# EasyEDA Pro project MyWordEdit.eprj, board PCB1 (continued)
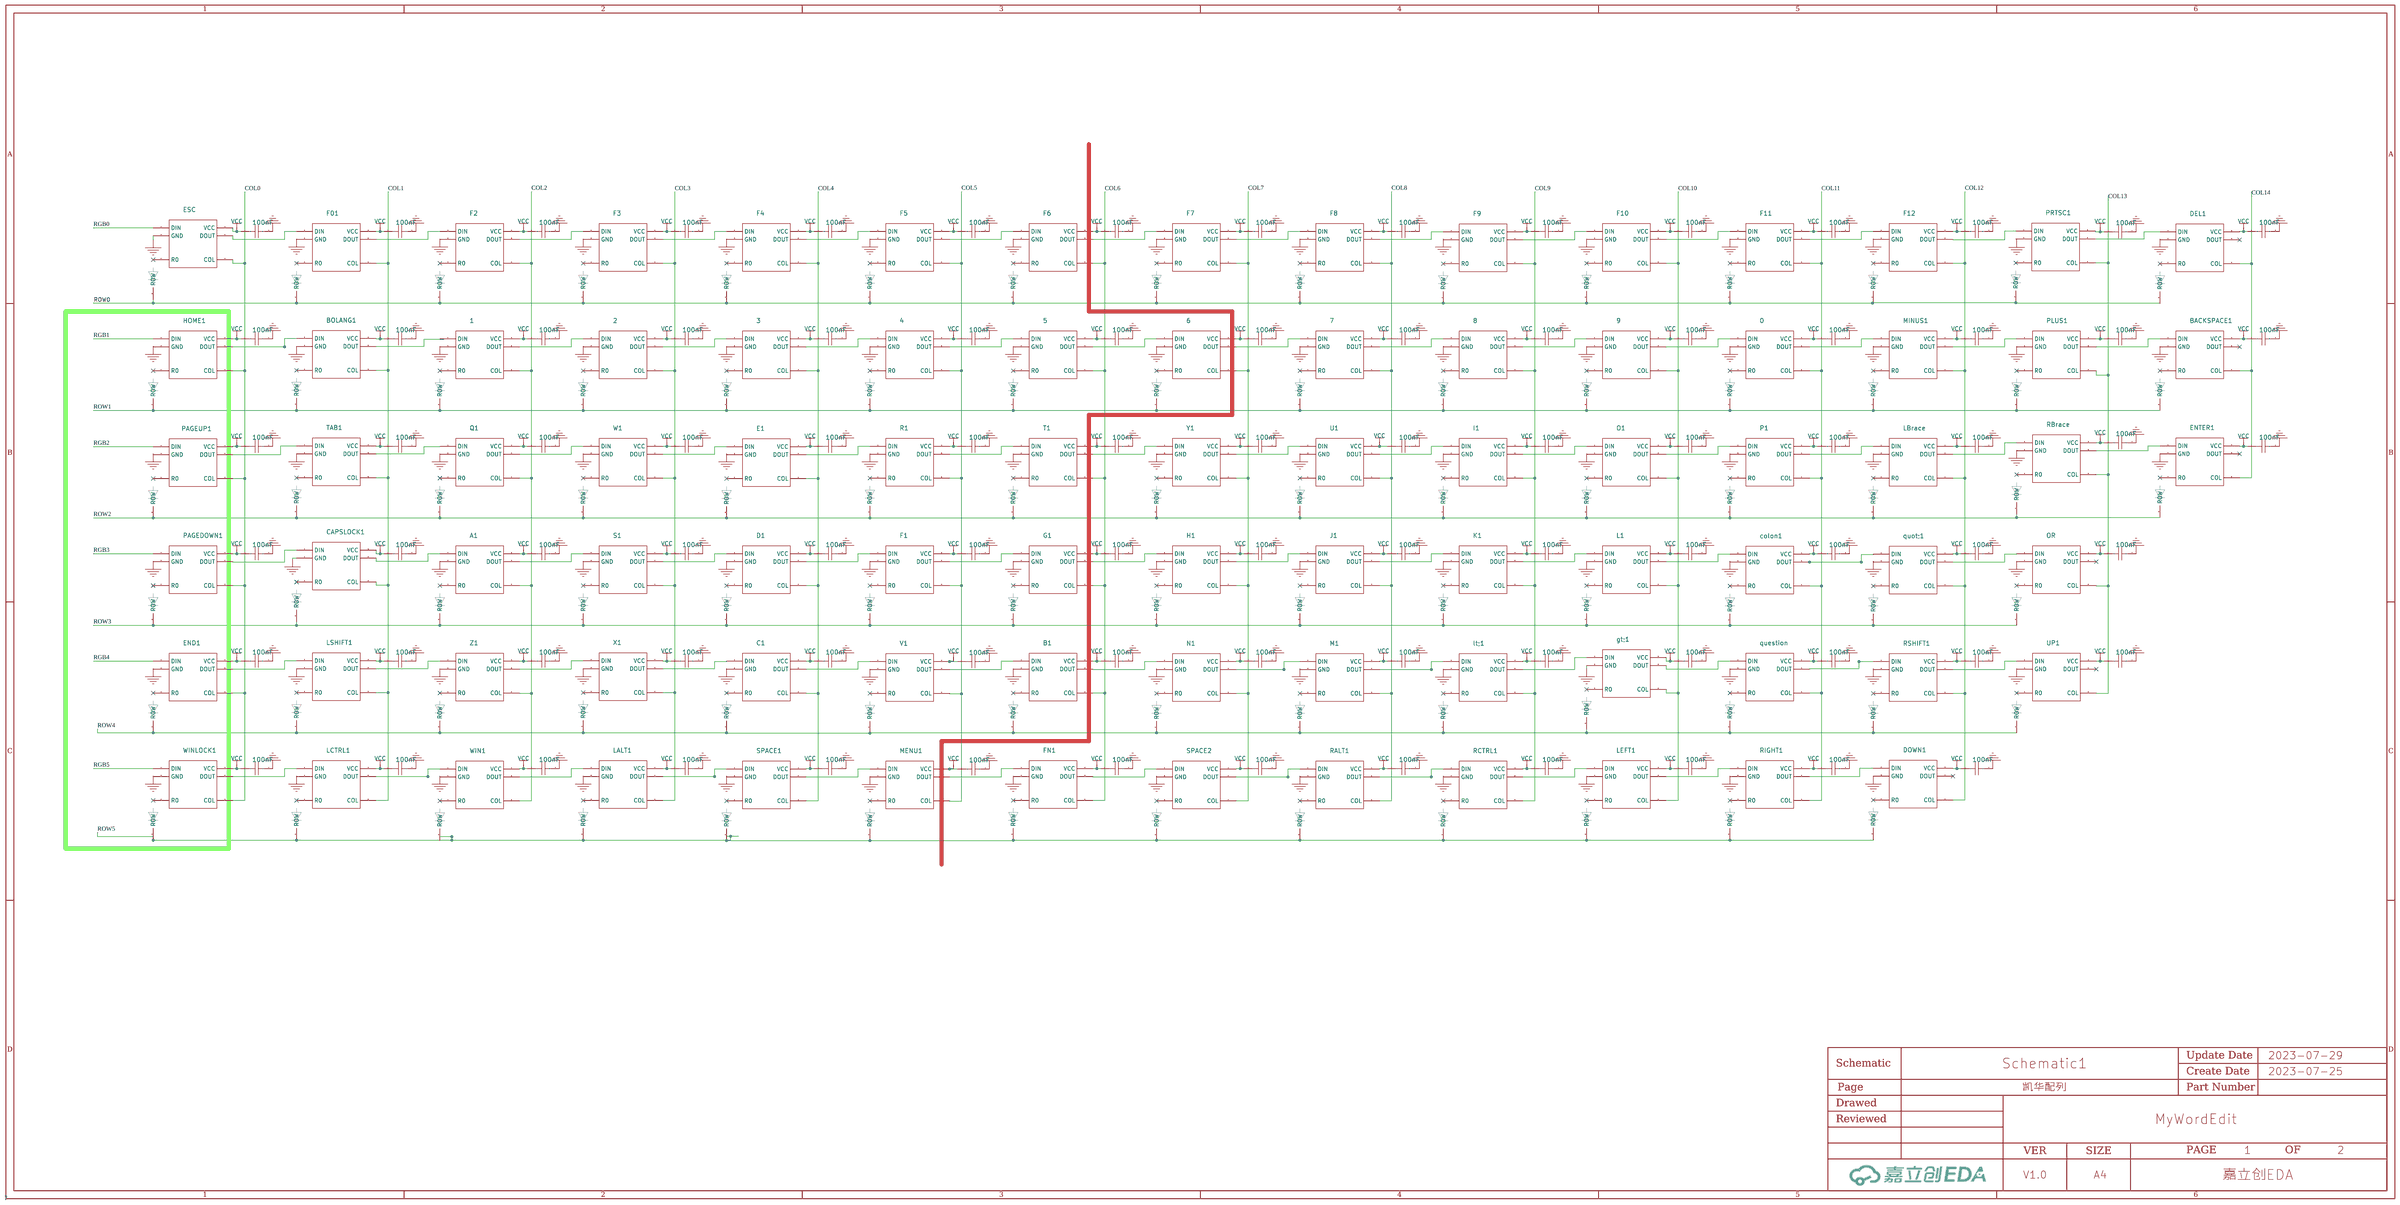
[diagram p0: 凯华配列]
## Routing (per net, layer and track width the routed paths; a pad name or vN(x,y) marks a point on that pad's centre or on a via; arc(x,y) is an arc through that point) (continued)
$2N29238: length 32
  Top Layer w0.254: v1(111.38,95) 112.14,94.23 116.46,94.23 117.6,93.09 129.41,93.09 129.79,92.71 137.29,92.71 138.05,93.47 138.05,94.49 v1(137.92,94.61)
  Bottom Layer w0.254: v1(137.92,94.61) 137.17,95.37 5.DIN ; v1(111.38,95) 111.42,95.03 4.DOUT
$2N29245: length 32.5
  Top Layer w0.254: v1(116.84,98.04) 111.51,103.38 109.22,103.38 108.08,104.52 98.17,104.52 95,101.35 93.85,101.35 92.84,100.33 92.84,98.42 v1(92.71,98.3)
  Bottom Layer w0.254: v1(92.71,98.3) 92.71,97.73 3.DOUT ; v1(116.84,98.04) 117.18,97.71 4.DIN
$2N29252: length 31.8
  Top Layer w0.254: v1(73.66,98.3) 74.3,97.66 89.92,97.66 91.57,96.01 99.38,96.01 100.08,96.7 v1(100.08,97.79)
  Bottom Layer w0.254: v1(73.66,98.3) 73.57,98.39 73.57,99.17 ; 3.DIN 99.2,98.67 v1(100.08,97.79)
$2N29259: length 32.5
  Top Layer w0.254: v1(79.12,101.22) 76.84,103.5 74.55,103.5 70.36,107.7 61.09,107.7 58.67,105.28 56.39,105.28 54.74,103.63 v1(54.74,101.73)
  Bottom Layer w0.254: 1.DOUT 54.74,101.16 v1(54.74,101.73) ; v1(79.12,101.22) 79.33,101.01 2.DIN
$2N29284: length 35.2
  Top Layer w0.254: v1(249.68,117.47) 251.84,119.63 251.84,120.4 256.54,125.09 275.08,125.09 275.84,124.33 v1(275.84,122.55)
  Bottom Layer w0.254: F12.DIN 275.84,121.78 v1(275.84,122.55) ; 251.72,117.72 251.48,117.47 v1(249.68,117.47)
$2N29291: length 36
  Top Layer w0.254: v1(259.21,119.25) 259.21,117.86 257.94,116.59 250.19,116.59 248.54,114.93 231.52,114.93 v1(230.63,115.82)
  Bottom Layer w0.254: v1(230.63,115.82) 230.88,116.07 F10.DOUT ; F11.DIN 258.6,119.86 v1(259.21,119.25)
$2N29298: length 34.7
  Top Layer w0.254: v1(238.25,119.25) 234.95,122.55 218.69,122.55 213.36,117.22 213.36,115.57 v1(212.09,114.3)
  Bottom Layer w0.254: F10.DIN 238.15,119.15 v1(238.25,119.25) ; F9.DOUT 212.21,114.42 v1(212.09,114.3)
$2N29305: length 36.1
  Top Layer w0.254: v1(221.23,116.46) 221.23,114.05 220.47,113.28 214.12,113.28 213.11,112.27 210.82,112.27 210.31,111.76 196.6,111.76 196.34,111.51 194.06,111.51 v1(192.91,112.65)
  Bottom Layer w0.254: v1(192.91,112.65) 193.03,112.77 F8.DOUT ; v1(221.23,116.46) 221.14,116.55 F9.DIN
$2N29312: length 34.8
  Top Layer w0.254: v1(200.03,116.08) 196.98,119.13 183.13,119.13 178.31,114.3 175.51,114.3 173.99,112.78 v1(173.99,111)
  Bottom Layer w0.254: F8.DIN 200.17,115.93 v1(200.03,116.08) ; v1(173.99,111) 174.11,111.12 F7.DOUT
$2N29319: length 43.7
  Top Layer w0.254: v1(148.97,111.76) 150.75,109.98 v1(158.5,109.98) ; v1(161.54,107.31) 168.72,107.31 169.91,108.51 176.2,108.51 177.8,110.11 181.99,110.11 183.01,111.12 v1(183.01,113.41)
  Bottom Layer w0.254: v1(161.54,107.31) 158.88,109.98 v1(158.5,109.98) ; F6.DOUT 150.89,111.76 v1(148.97,111.76) ; F7.DIN 182.85,113.25 v1(183.01,113.41)
$2N29326: length 31.6
  Top Layer w0.254: v1(156.85,113.79) 155.7,114.93 150.31,114.93 146.24,119 135.64,119 132.46,115.82 132.46,114.17 v1(132.33,114.05)
  Bottom Layer w0.254: F6.DIN 156.8,113.75 v1(156.85,113.79) ; v1(132.33,114.05) 132.33,113.48 F5.DOUT
$2N29333: length 35.9
  Top Layer w0.254: v1(111.51,115.06) 113.03,113.54 114.05,113.54 114.3,113.28 126.11,113.28 128.14,111.25 130.18,111.25 130.68,111.76 138.94,111.76 139.83,112.65 v1(139.83,114.3)
  Bottom Layer w0.254: v1(111.51,115.06) 113.05,115.06 113.2,114.91 ; F5.DIN 139.71,114.42 v1(139.83,114.3)
$2N29340: length 32
  Top Layer w0.254: v1(119,117.09) 115.57,120.52 110.87,120.52 109.09,122.3 97.28,122.3 94.62,119.63 94.62,117.73 v1(94.23,117.35)
  Bottom Layer w0.254: F4.DIN 119,116.11 v1(119,117.09) ; F3.DOUT 94.15,117.26 v1(94.23,117.35)
$2N29347: length 36
  Top Layer w0.254: v1(101.6,117.6) 101.22,117.22 101.22,115.32 100.84,114.93 95.38,114.93 95.12,115.19 94.74,115.19 94.11,114.55 89.54,114.55 87.38,116.71 75.06,116.71 v1(73.41,118.36)
  Bottom Layer w0.254: v1(101.6,117.6) 101.48,117.72 F3.DIN ; v1(73.41,118.36) 75.08,118.36 F2.DOUT
$2N29354: length 31.3
  Top Layer w0.254: v1(81.03,120.27) 79.05,122.25 72.28,122.25 70.3,120.27 66.04,120.27 63.12,123.19 57.28,123.19 56.26,122.17 v1(56.26,120.65)
  Bottom Layer w0.254: F2.DIN 80.98,120.23 v1(81.03,120.27) ; v1(56.26,120.65) 56.26,119.96 F01.DOUT
$2N36381: length 36.1
  Top Layer w0.254: v1(268.73,119.13) 269.49,118.36 282.58,118.36 283.46,119.25 288.04,119.25 288.54,119.76 288.54,119.89 296.29,119.89 297.43,121.03 v1(297.43,122.3)
  Bottom Layer w0.254: v1(268.73,119.13) 268.98,119.37 F12.DOUT ; v1(297.43,122.3) 296.58,123.16 PRTSC1.DIN
$2N36513: length 32.5
  Top Layer w0.254: v1(61.98,101.22) 61.98,99.82 61.6,99.44 53.34,99.44 50.93,101.85 46.74,101.85 45.85,100.96 36.45,100.96 v1(35.81,101.6)
  Bottom Layer w0.254: BOLANG1.DOUT 35.81,102.38 v1(35.81,101.6) ; 1.DIN 61.1,102.1 v1(61.98,101.22)
$2N38445: length 29.8
  Top Layer w0.254: v1(97.79,42.42) 97.28,42.93 89.79,42.93 88.9,42.04 87.88,42.04 84.84,45.08 74.8,45.08 73.79,44.07 v1(73.79,42.54)
  Bottom Layer w0.254: Z1.DOUT 73.79,42.36 v1(73.79,42.54) ; X1.DIN 98,42.21 v1(97.79,42.42)
$2N38463: length 29.2
  Top Layer w0.254: v1(135.51,39.37) 135.26,39.62 124.21,39.62 121.92,41.91 112.78,41.91 111.63,40.77 v1(111.63,39.37)
  Bottom Layer w0.254: v1(111.63,39.37) 111.63,38.93 C1.DOUT ; V1.DIN 135.97,38.9 v1(135.51,39.37)
$2N38472: length 34.1
  Top Layer w0.254: v1(130.56,35.94) 131.19,35.31 133.86,35.31 134.11,35.05 138.05,35.05 140.34,37.34 141.61,37.34 145.16,33.78 156.21,33.78 157.1,34.67 v1(157.1,35.31)
  Bottom Layer w0.254: B1.DIN 155.97,36.44 v1(157.1,35.31) ; v1(130.56,35.94) 130.56,36.59 V1.DOUT
$2N38479: length 48.1
  Top Layer w0.254: v1(159,37.59) 158.62,37.97 150.11,37.97 149.48,37.34 v1(149.48,35.94) ; v1(164.08,37.59) 164.26,37.77 166.83,37.77 v1(167.01,37.59) ; v1(191.01,38.99) 187.96,38.99 187.2,39.75 173.1,39.75 v1(171.07,37.72)
  Bottom Layer w0.254: v1(159,37.59) v1(164.08,37.59) ; v1(167.01,37.59) 167.25,37.84 170.95,37.84 v1(171.07,37.72) ; B1.DOUT 149.48,35.63 v1(149.48,35.94) ; v1(191.01,38.99) 191.9,38.99 192.68,38.21 N1.DIN
$2N38485: length 37.1
  Top Layer w0.254: v1(213.74,38.73) 213.74,37.08 212.85,36.19 200.28,36.19 199.14,37.34 197.74,37.34 194.95,34.54 186.06,34.54 185.29,35.31 v1(185.17,35.31)
  Bottom Layer w0.254: v1(213.74,38.73) 213.14,39.34 M1.DIN ; 187.21,35.55 185.41,35.55 v1(185.17,35.31)
$2N38500: length 29.8
  Top Layer w0.254: v1(230.25,42.04) 229.74,42.54 225.04,42.54 222.89,40.39 218.82,40.39 218.06,41.15 207.65,41.15 206.5,40 v1(206.5,37.97)
  Bottom Layer w0.254: v1(230.25,42.04) 230.65,41.63 lt;1.DIN ; v1(206.5,37.97) 206.5,37.57 M1.DOUT
$2N38515: length 34.9
  Top Layer w0.254: v1(251.08,41.91) 251.08,40 250.57,39.5 238.76,39.5 238.38,39.88 235.46,39.88 233.3,37.72 224.28,37.72 v1(223.39,38.61)
  Bottom Layer w0.254: gt;1.DIN 250.35,42.64 v1(251.08,41.91) ; lt;1.DOUT 224.94,38.61 v1(223.39,38.61)
$2N40060: length 36.3
  Top Layer w0.254: v1(320.04,49.91) 319.28,50.67 314.07,50.67 311.02,47.62 290.2,47.62 289.31,46.74 v1(289.31,45.21)
  Bottom Layer w0.254: UP1.DIN 320.7,49.25 v1(320.04,49.91) ; v1(289.31,45.21) 289.31,44.56 RSHIFT1.DOUT
$2N41293: length 36.2
  Top Layer w0.254: v1(305.44,27.56) 305.44,25.53 304.93,25.02 291.97,25.02 291.21,25.78 289.69,25.78 287.4,23.5 278,23.5 v1(277.24,24.26)
  Bottom Layer w0.254: v1(305.44,27.56) 304.7,28.29 RIGHT1.DIN ; v1(277.24,24.26) 277.49,24.5 LEFT1.DOUT
$2N41300: length 40.7
  Top Layer w0.254: v1(11.18,36.83) 11.68,36.32 18.92,36.32 23.88,31.37 23.88,27.81 26.8,24.89 38.99,24.89 39.37,25.27 v1(39.37,26.8)
  Bottom Layer w0.254: LCTRL1.DIN 38.62,27.55 v1(39.37,26.8) ; WINLOCK1.DOUT 11.18,37.48 v1(11.18,36.83)
$2N41351: length 34.8
  Top Layer w0.254: v1(60.83,26.42) 60.2,27.05 58.55,27.05 55.12,30.48 39.12,30.48 37.97,29.34 32.51,29.34 31.62,28.45 v1(31.62,27.05)
  Bottom Layer w0.254: v1(60.83,26.42) 60.83,25.56 WIN1.DIN ; v1(31.62,27.05) 31.62,26.74 LCTRL1.DOUT
$2N41356: length 39.5
  Top Layer w0.254: v1(55.37,23.5) 56.01,22.86 66.04,22.86 67.82,24.64 69.72,24.64 73.66,20.7 86.23,20.7 87,21.46 v1(87,22.61)
  Bottom Layer w0.254: v1(55.37,23.5) 55.03,23.84 WIN1.DOUT ; LALT1.DIN 86.24,23.36 v1(87,22.61)
$2N41358: length 43.4
  Top Layer w0.254: v1(78.87,22.99) 78.87,23.88 79.88,24.89 91.57,24.89 92.33,24.13 114.05,24.13 116.15,22.02 117.3,22.02 v1(117.73,21.59)
  Bottom Layer w0.254: v1(78.87,22.99) 78.87,22.29 LALT1.DOUT ; SPACE1.DIN 117.73,20.61 v1(117.73,21.59)
$2N41363: length 45.2
  Top Layer w0.254: v1(150.5,17.14) 150.5,16 149.61,15.11 139.95,15.11 138.56,16.51 125.6,16.51 124.59,15.49 123.57,15.49 121.16,17.91 112.9,17.91 v1(112.27,18.54)
  Bottom Layer w0.254: v1(112.27,18.54) 112.27,19.07 SPACE1.DOUT ; v1(150.5,17.14) 149.87,17.77 MENU1.DIN
$2N41367: length 46.4
  Top Layer w0.254: v1(143.26,17.27) 143.26,18.92 143.64,19.3 149.86,19.3 150.75,18.41 156.69,18.41 157.61,17.5 177.14,17.5 178.69,19.05 184.15,19.05 v1(184.4,18.8)
  Bottom Layer w0.254: v1(184.4,18.8) 184.81,18.39 FN1.DIN ; MENU1.DOUT 143.26,17.09 v1(143.26,17.27)
$2N41371: length 47.8
  Top Layer w0.254: v1(217.68,19.81) 217.68,18.16 216.79,17.27 205.23,17.27 203.45,15.49 186.18,15.49 185.29,14.6 178.44,14.6 v1(177.55,15.49)
  Bottom Layer w0.254: v1(177.55,15.49) 177.79,15.74 FN1.DOUT ; SPACE2.DIN 216.95,20.54 v1(217.68,19.81)
$2N41376: length 41
  Top Layer w0.254: v1(210.44,19.18) 210.44,21.08 211.2,21.84 236.6,21.84 239.4,24.64 245.49,24.64 v1(246,24.13)
  Bottom Layer w0.254: SPACE2.DOUT 210.44,18.65 v1(210.44,19.18) ; v1(246,24.13) 246.53,23.6 RALT1.DIN
$2N41381: length 36.4
  Top Layer w0.254: v1(239.14,20.95) 239.9,20.19 249.05,20.19 251.59,22.73 252.73,22.73 253.75,21.72 266.83,21.72 267.46,22.35 267.46,23.88 v1(267.21,24.13)
  Bottom Layer w0.254: v1(239.14,20.95) 240.81,20.95 241.06,21.2 ; v1(267.21,24.13) 266.35,24.99 RCTRL1.DIN
$2N41386: length 31.9
  Top Layer w0.254: v1(283.97,27.56) 280.54,30.99 277.37,30.99 275.97,29.59 263.4,29.59 260.35,26.54 v1(260.35,23.62)
  Bottom Layer w0.254: v1(260.35,23.62) 260.35,23.22 RCTRL1.DOUT ; LEFT1.DIN 284.5,27.03 v1(283.97,27.56)
$2N42631: length 35.9
  Top Layer w0.254: v1(314.2,126.36) 287.53,126.36 286.64,125.48 286.64,122.94 v1(288.16,121.41)
  Bottom Layer w0.254: DEL1.DIN 314.2,124.92 v1(314.2,126.36) ; PRTSC1.DOUT 288.55,121.02 v1(288.16,121.41)
$2N42705: length 28.7
  Top Layer w0.254: v1(17.78,112.78) 17.91,112.78 18.54,112.14 29.72,112.14 35.69,106.17 39.5,106.17 v1(41.02,104.65)
  Bottom Layer w0.254: v1(41.02,104.65) 41.36,104.31 BOLANG1.DIN ; HOME1.DOUT 17.44,113.12 v1(17.78,112.78)
$2N42720: length 41.3
  Top Layer w0.254: v1(315.34,78.1) 304.55,88.9 287.53,88.9 283.46,84.84 v1(283.46,83.06)
  Bottom Layer w0.254: 315.85,77.6 v1(315.34,78.1) ; v1(283.46,83.06) 283.47,83.05 RBrace.DOUT
$2N42725: length 41
  Top Layer w0.254: v1(46.36,83.82) 46.36,82.68 45.34,81.66 33.27,81.66 31.62,83.31 31.62,85.09 23.62,93.09 17.02,93.09 v1(16.26,93.85)
  Bottom Layer w0.254: TAB1.DIN 45.86,84.32 v1(46.36,83.82) ; PAGEUP1.DOUT 15.79,94.32 v1(16.26,93.85)
$2N42734: length 34.8
  Top Layer w0.254: v1(67.95,83.44) 67.95,83.57 67.44,84.07 60.58,84.07 59.82,83.31 56.52,83.31 53.47,86.36 40.13,86.36 38.99,85.22 v1(38.99,83.95)
  Bottom Layer w0.254: v1(67.95,83.44) 68.16,83.23 Q1.DIN ; TAB1.DOUT 38.99,83.51 v1(38.99,83.95)
$2N42746: length 28.6
  Top Layer w0.254: v1(271.02,62.74) 271.02,64.26 271.91,65.15 286.64,65.15 288.42,66.93 v1(294.64,66.93)
  Bottom Layer w0.254: quot;1.DOUT 271.02,62.09 v1(271.02,62.74) ; OR.DIN 295.42,66.15 v1(294.64,66.93)
$2N42752: length 45.3
  Top Layer w0.254: v1(42.67,43.69) 43.31,43.05 51.69,43.05 53.59,44.96 63.5,44.96 68.07,40.39 80.26,40.39 80.65,40.77 v1(80.65,42.04)
  Bottom Layer w0.254: v1(42.67,43.69) 42.67,44.34 LSHIFT1.DOUT ; Z1.DIN 79.64,43.04 v1(80.65,42.04)
$2N42761: length 33.4
  Top Layer w0.254: v1(92.58,39.37) 93.22,38.73 100.46,38.73 102.62,40.89 105.28,40.89 109.09,37.08 118.36,37.08 118.62,37.34 v1(118.62,38.99)
  Bottom Layer w0.254: X1.DOUT 92.58,39.9 v1(92.58,39.37) ; v1(118.62,38.99) 117.87,39.74 C1.DIN
$2N43010: length 35.6
  Top Layer w0.254: v1(250.44,60.07) 251.33,59.18 258.57,59.18 260.48,61.09 264.67,61.09 264.92,60.83 277.37,60.83 278.38,61.85 v1(278.38,64.13)
  Bottom Layer w0.254: quot;1.DIN 278.35,64.1 v1(278.38,64.13) ; colon1.DOUT 251.86,60.2 250.83,60.2 250.7,60.07 v1(250.44,60.07)
$2N43134: length 43.1
  Top Layer w0.254: v1(296.93,45.97) 296.93,44.83 295.64,43.55 291.33,43.55 290.7,42.93 274.07,42.93 272.29,41.15 262,41.15 v1(261.24,41.91)
  Bottom Layer w0.254: RSHIFT1.DIN 296.32,46.58 v1(296.93,45.97) ; v1(261.24,41.91) 261.49,42.16 question.DOUT
$2N43163: length 30.9
  Top Layer w0.254: v1(321.95,30.86) 319.02,33.78 311.53,33.78 307.34,29.59 298.83,29.59 298.2,28.96 v1(298.2,26.92)
  Bottom Layer w0.254: 297.95,26.15 298.2,26.4 v1(298.2,26.92) ; v1(321.95,30.86) 322.35,30.46 DOWN1.DIN
$2N69049: length 35.2
  Top Layer w0.254: v1(35.48,121.52) 37.11,119.89 50.93,119.89 52.58,118.24 62.87,118.24 63.5,118.87 63.5,120.78 v1(63.63,120.9)
  Bottom Layer w0.254: v1(63.63,120.9) 63.51,121.02 F01.DIN ; ESC.DOUT v1(35.48,121.52)
$2N69230: length 36.3
  Top Layer w0.254: v1(14.61,74.8) 15.37,74.04 23.37,74.04 28.58,68.83 42.67,68.83 45.09,66.42 v1(45.09,66.17)
  Bottom Layer w0.254: 14.14,75.67 14.61,75.2 v1(14.61,74.8) ; CAPSLOCK1.DIN 45.17,66.08 v1(45.09,66.17)
$2N69279: length 39.1
  Top Layer w0.254: v1(72.9,61.98) 72.9,60.58 72.39,60.07 50.8,60.07 48.39,62.48 40.39,62.48 v1(39.75,63.12)
  Bottom Layer w0.254: v1(39.75,63.12) 39.75,63.64 CAPSLOCK1.DOUT ; v1(72.9,61.98) 72.02,62.85 A1.DIN
$2N69336: length 30
  Top Layer w0.254: v1(244.35,41.27) 244.35,43.18 245.62,44.45 254.89,44.45 256.54,42.8 258.95,42.8 261.75,45.59 267.46,45.59 v1(267.84,45.21)
  Bottom Layer w0.254: question.DIN 268.5,44.56 v1(267.84,45.21) ; v1(244.35,41.27) 244.35,40.75 244.1,40.5
$3N1337: length 19
  Top Layer w0.254: v1(170.05,52.96) v1(170.05,46.1)
  Bottom Layer w0.254: v1(170.05,52.96) 169.67,53.34 167.64,53.34 165.89,55.09 165.89,56.23 164.08,58.04 R2.1 ; U6.13 169.51,46.64 v1(170.05,46.1)
$3N1341: length 10.3
  Top Layer w0.254: v1(44.83,8.51) 40.39,8.51 v1(38.23,6.35)
  Bottom Layer w0.254: U4.4 44.98,8.51 v1(44.83,8.51) ; C10.1 36.87,6.35 v1(38.23,6.35)
$3N1343: length 12.7
  Top Layer w0.254: v1(66.42,6.1) 68.71,8.38 72.9,8.38 v1(74.17,7.11)
  Bottom Layer w0.254: v1(66.42,6.1) 66.42,5.33 66.29,5.21 65.19,5.21 C14.1 ; v1(74.17,7.11) 73.49,6.43 U3.4
$3N1436: length 16.6
  Bottom Layer w0.254: R13.1 105.04,123.75 96.72,123.75 95.25,125.22 95.25,127.51 95.76,128.02 U5.7
$3N1469: length 12.3
  Bottom Layer w0.254: RPROG.2 112.74,126.4 112.27,126.87 108.84,126.87 108.59,127.13 105.41,127.13 104.52,128.02 U5.2
$3N1530: length 7.4
  Bottom Layer w0.254: BOOT.3 169.42,12.57 165.61,12.57 164.97,13.21 R3.1
$3N1533: length 11.1
  Top Layer w0.254: v1(154.05,127.63) v1(155.7,127.63)
  Bottom Layer w0.254: 148.25,127.76 148.34,127.67 154.01,127.67 v1(154.05,127.63) ; BTK-05.25 157.84,129.77 v1(155.7,127.63)
$3N1536: length 21.3
  Top Layer w0.254: v1(153.54,125.22) v1(160.02,125.22)
  Bottom Layer w0.254: v1(153.54,125.22) R6.1 ; BTK-05.31 166.84,129 163.07,125.22 v1(160.02,125.22)
$3N1539: length 3.4
  Bottom Layer w0.254: BOOT.4 167.39,10.54 R4.2
$3N1540: length 140
  Top Layer w0.254: v1(73.79,129.03) v1(77.09,129.03) ; STATE_LED.1 17.11,130.3 v1(17.53,130.3)
  Bottom Layer w0.254: v1(73.79,129.03) 72.91,129.03 71.99,128.11 60.67,128.11 59.71,127.15 38.46,127.15 37.3,128.31 36.2,128.31 35.81,128.7 35.81,129.67 35.23,130.25 17.58,130.25 v1(17.53,130.3) ; v1(77.09,129.03) 78.74,127.38 89.4,127.38 93.75,123.04 125.96,123.04 130.56,127.63 R7.2
$3N1541: length 131.7
  Top Layer w0.254: v1(73.15,128.4) 76.58,128.4 v1(77.98,127) ; CAPS_LED.1 22.06,128.62 v1(23.11,129.67)
  Bottom Layer w0.254: v1(73.15,128.4) 72.51,127.75 60.81,127.75 59.86,126.8 38.3,126.8 37.21,127.89 36.12,127.89 35.43,128.58 35.43,129.41 34.95,129.9 23.34,129.9 v1(23.11,129.67) ; R6.2 128.65,125.22 126.11,122.68 93.6,122.68 89.28,127 v1(77.98,127)
$3N1559: length 46.1
  Top Layer w0.254: v1(77.09,129.92) 73.8,129.92 71.77,127.89 LED_CHRG.2
  Bottom Layer w0.254: R13.2 106.29,123.39 93.89,123.39 89.55,127.74 79.21,127.74 77.09,129.86 v1(77.09,129.92)
$3N1581: length 6.1
  Top Layer w0.254: v1(4.32,125.22) 3.78,125.76 PWR_EN_LED.1
  Bottom Layer w0.254: v1(4.32,125.22) 4.45,125.35 R9.1

## Copper pours and planes (outline as drawn; the poured copper is in the pictures)
GND on Bottom Layer: -21.59,146.18 350.77,146.18 350.77,-13.34 -21.59,-13.34

Small or netless copper shapes (teardrops, artwork), in the pictures only: 1241 on Top Layer, 2756 on Bottom Layer

## Text on the board
Top Silkscreen Layer: By Megre / 2023.07.28
